# EasyEDA Pro project Arduino UNO DIY.eprj, board Arduino_Uno_Kit_ASCII
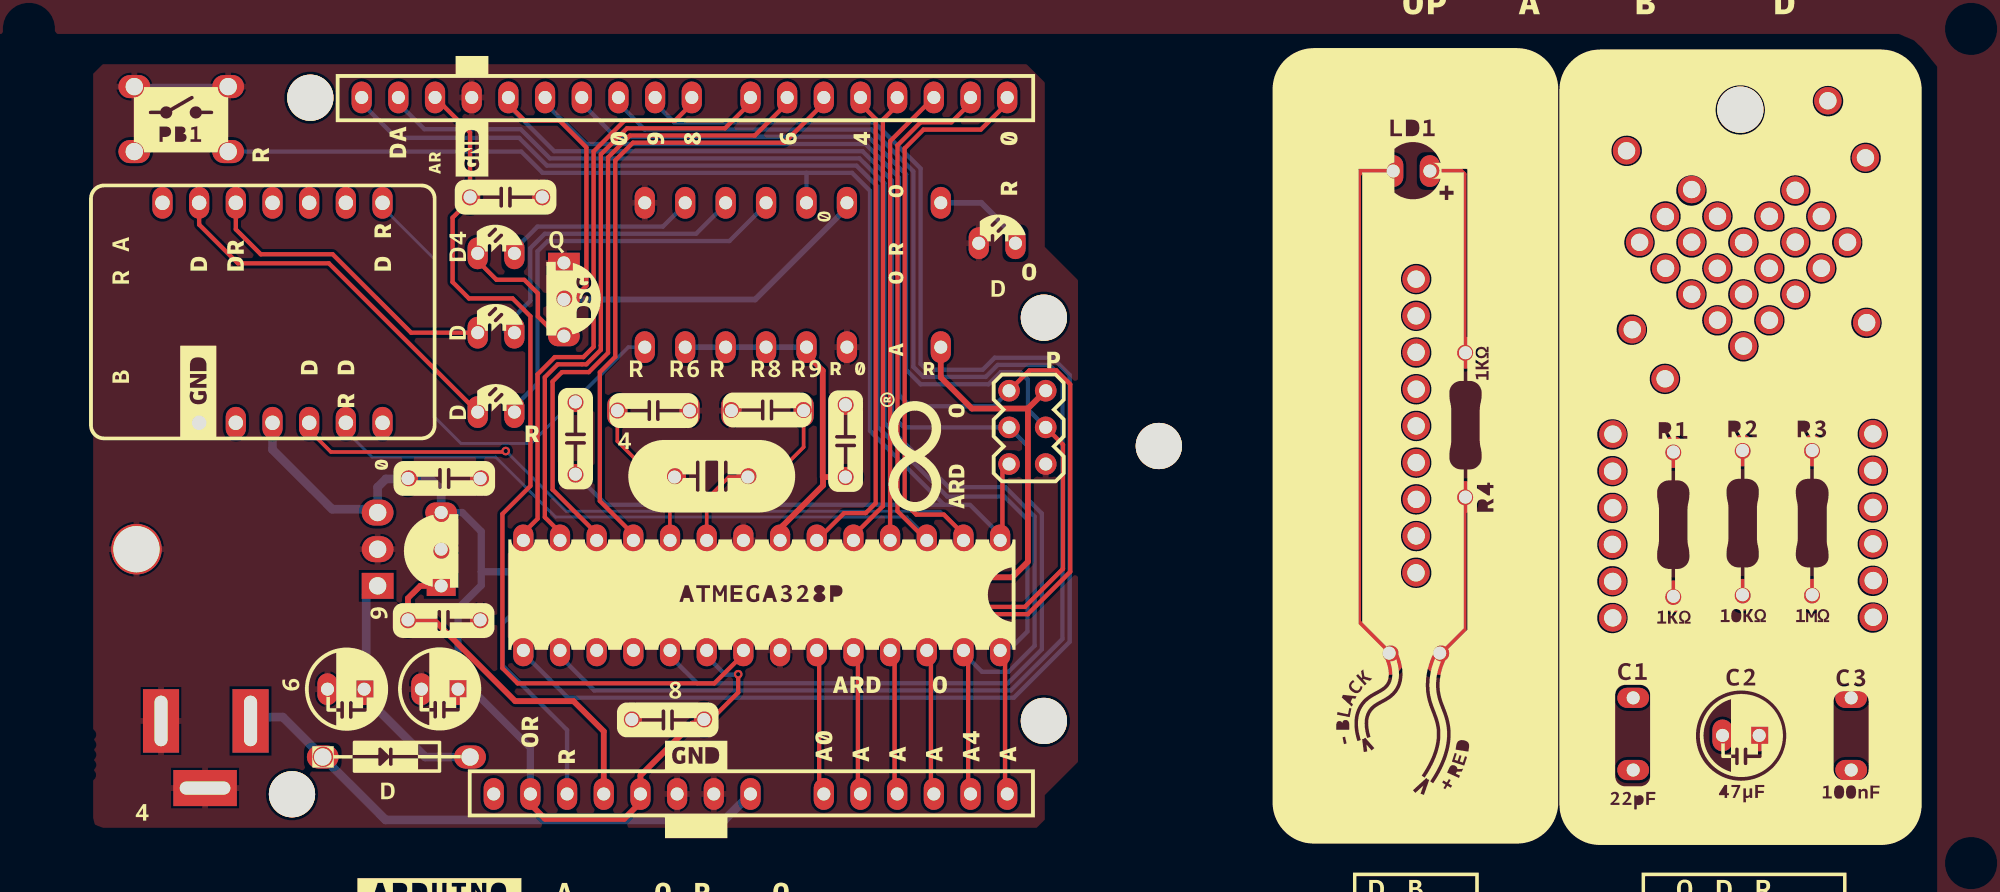
[diagram p6: board, top side]
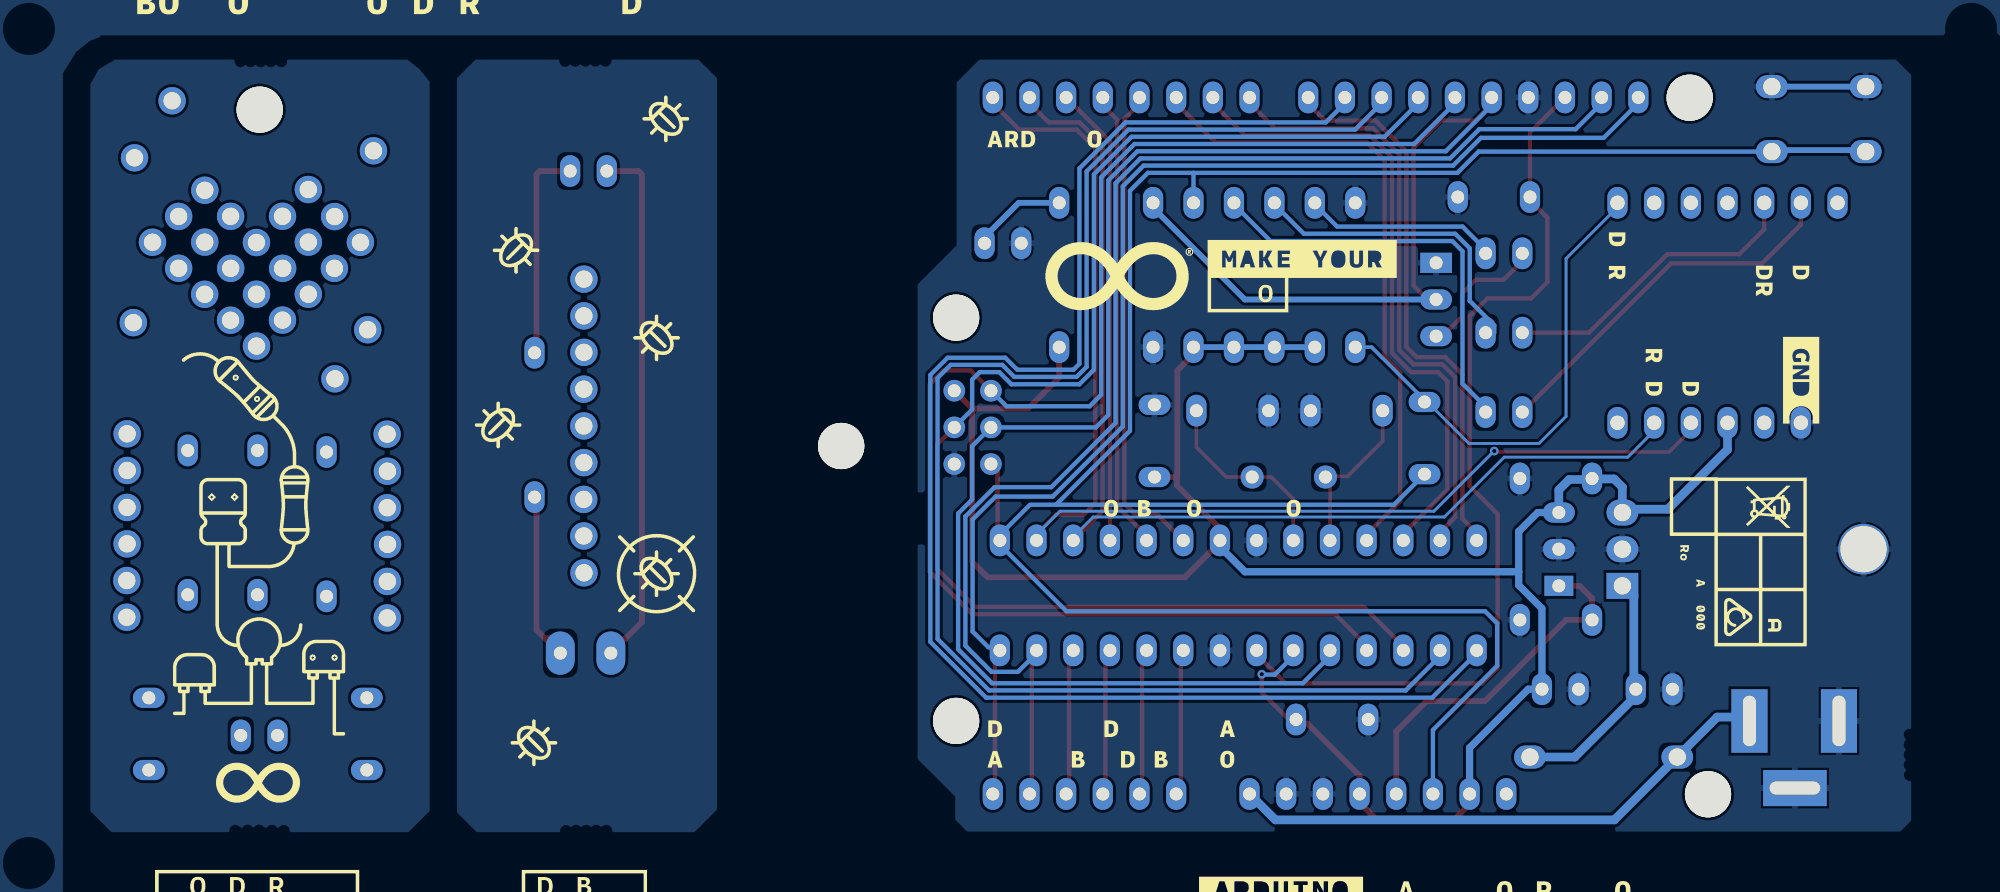
[diagram p7: board, bottom side, seen from below]

No outline. copper layers: Top Layer, Bottom Layer. Coordinates in mm from the lowest, leftmost part position.
Stack: Top Layer 0.018mm / Dielectric2 1.564mm FR-4 er 4.8 / Bottom Layer 0.018mm

## Design rules (mm)
net U1: Aruino_Uno_Kit
net PB1: Aruino_Uno_Kit
net D1: Aruino_Uno_Kit
net Q1: Aruino_Uno_Kit
net U2: Aruino_Uno_Kit
net Y1: Aruino_Uno_Kit
net U3: Aruino_Uno_Kit
net R24: Aruino_Uno_Kit
net J5: Aruino_Uno_Kit
net R1: Aruino_Uno_Kit
net R7: Aruino_Uno_Kit
net R8: Aruino_Uno_Kit
net R2: Aruino_Uno_Kit
net J2: Aruino_Uno_Kit
net J6: Aruino_Uno_Kit
net R3: Aruino_Uno_Kit
net R4: Aruino_Uno_Kit
net R5: Aruino_Uno_Kit
net R9: Aruino_Uno_Kit
net R11: Aruino_Uno_Kit
net R10: Aruino_Uno_Kit
net R6: Aruino_Uno_Kit
net C5: Aruino_Uno_Kit
net C3: Aruino_Uno_Kit
net C4: Aruino_Uno_Kit
net LD3: Aruino_Uno_Kit
net LD1: Aruino_Uno_Kit
net LD2: Aruino_Uno_Kit
net LD4: Aruino_Uno_Kit
net LD5: Aruino_Uno_Kit
net J7: Aruino_Uno_Kit
net C1: Aruino_Uno_Kit
net J3: Aruino_Uno_Kit
net C2: Aruino_Uno_Kit
net J1: Aruino_Uno_Kit
net J4: Aruino_Uno_Kit
net C7: Aruino_Uno_Kit
net C8: Aruino_Uno_Kit
net C6: Aruino_Uno_Kit
net C9: Aruino_Uno_Kit
net C10: Aruino_Uno_Kit
net C11: Aruino_Uno_Kit
net C13: Aruino_Uno_Kit
net C12: Aruino_Uno_Kit
spacing BoardOutlineClearance: track to track 0.2, other pairs 0.127 to 0.3
spacing Silks: track to track 0.2, other pairs 0.127 to 0.3
spacing Generic clearance 0.127mm: track to track 0.2, other pairs 0.127 to 0.3
spacing COPPER_0.3mm: track to track 0.2, other pairs 0.127 to 0.3
spacing safeClearance (default): track to track 0.2, other pairs 0.127 to 0.3
track width StandardTraces (default): min 0.127, default 0.4, max 5
differential pair USB (default): width min 0.15, default 0.2, max 0.21; gap min 0.15, default 0.15
via StandardVias (default): diameter min 0.6, default 0.6, max 0.6; hole min 0.3, default 0.3, max 0.3

## Placement (name value [footprint] x y rotation side)
C1  -  [TS170R1H220JSANB0R]  111.1 8.95 90 top
C2  -  [EKF476M1EE05TU]  118.56 8.85 0 top
C3  -  [B32529C0104J289]  126.2 8.95 90 top
C4  -  [TS170R1H220JSANB0R]  43.25 31.35 0 top
C5  -  [TS170R1H220JSANB0R]  51.15 31.35 180 top
C6  -  [EKF476M1EE05TU]  21.95 12.05 0 top
C7  -  [EKF476M1EE05TU]  28.45 12.05 0 top
C8  -  [B32529C0104J289]  44.25 9.95 180 top
C9  -  [B32529C0104J289]  28.75 16.85 0 top
C10  -  [B32529C0104J289]  28.75 26.65 0 top
C11  -  [B32529C0104J289]  33.05 46.15 0 top
C12  -  [B32529C0104J289]  37.85 29.45 90 top
C13  -  [B32529C0104J289]  56.55 29.25 90 top
D1  1N4007G-T  [1N4007G-T-Footprint-1]  25.35 7.35 0 top
J1  20TW-995  [1X14-CUSTOM]  49.97 4.79 0 top
J2  20TW-994  [1X18-CUSTOM]  49.97 53.05 180 top
J3  PH2-06-UA  [2X03]  69.15 30.19 90 top
J4  19TW-746  [POWERSUPPLY_DC-21MM]  9.15 9.85 0 top
J5  -  [USB-C Serial-Footprint (16U2)]  16.17 38.13 270 top
J6  -  [MK125002GO]  95.95 14.55 180 top
J7  ICS-328-T  [ICS-328-T-Footprint-1]  50.65 18.45 180 top
LD1  L-7104YD  [L314YD-Footprint-1]  95.75 47.95 180 top
LD2  L-7104YD  [L314YD-Footprint-1]  32.35 31.25 180 top
LD3  L-7104YD  [L314YD-Footprint-1]  32.35 36.75 180 top
LD4  L-7104YD  [L314YD-Footprint-1]  32.35 42.25 180 top
LD5  L-7104GD  [L314YD-Footprint-1]  67.05 42.95 180 top
NOREF  -  [Pad_ie141]  118.52 52.2 0 top
NOREF#2  -  [Pad_ie91]  115.15 39.42 90 top
NOREF#3  -  [Pad_ie90]  113.34 41.21 90 top
NOREF#4  -  [Pad_ie110]  72.73 22.48 90 top
NOREF#5  -  [Pad_ie103]  4.26 7.5 270 top
NOREF#6  -  [Pad_ie96]  115.15 43.02 90 top
NOREF#7  -  [Pad_ie109]  72.72 23.18 90 top
NOREF#8  -  [Pad_ie118]  95.91 2.25 0 top
NOREF#9  -  [Pad_ie137]  122.32 46.62 90 top
NOREF#10  -  [Pad_ie82]  96.07 22.67 90 top
NOREF#11  -  [Pad_ie78]  109.66 22.08 90 top
NOREF#12  -  [Pad_ie62]  96.06 20.12 90 top
NOREF#13  -  [Pad_ie128]  94.57 55.58 0 top
NOREF#14  -  [Pad_ie121]  97.31 2.24 0 top
NOREF#15  -  [Pad_ie93]  120.53 41.21 90 top
NOREF#16  -  [Pad_ie72]  127.7 24.64 90 top
NOREF#17  -  [Pad_ie79]  109.68 24.62 90 top
NOREF#18  -  [Pad_ie70]  127.72 17.03 90 top
NOREF#19  -  [Pad_ie94]  122.33 39.41 90 top
NOREF#20  -  [Pad_ie148]  18.22 4.77 0 top
NOREF#21  -  [Pad_ie146]  70.29 9.85 0 top
NOREF#22  -  [Pad_ie142]  95.27 55.59 0 top
NOREF#23  -  [Pad_ie116]  120.21 2.25 0 top
NOREF#24  -  [Pad_ie105]  4.26 8.9 270 top
NOREF#25  -  [Pad_ie61]  118.74 39.42 90 top
NOREF#26  -  [Pad_ie73]  127.7 22.12 90 top
NOREF#27  -  [Pad_ie135]  115.15 46.67 90 top
NOREF#28  -  [Pad_ie139]  124.13 44.81 90 top
NOREF#29  -  [Pad_ie122]  119.15 55.55 180 top
NOREF#30  -  [Pad_ie145]  70.29 37.79 0 top
NOREF#31  -  [Pad_ie133]  116.94 44.82 90 top
NOREF#32  -  [Pad_ie119]  95.21 2.25 0 top
NOREF#33  -  [Pad_ie89]  96.07 35.39 90 top
NOREF#34  -  [Pad_ie71]  127.72 19.58 90 top
NOREF#35  -  [Pad_ie124]  117.75 55.55 0 top
NOREF#36  -  [Pad_ie115]  116.85 2.25 0 top
NOREF#37  -  [Pad_ie117]  96.61 2.25 180 top
NOREF#38  -  [Pad_ie99]  0 0 90 top
NOREF#39  -  [Pad_ie126]  119.85 55.55 0 top
NOREF#40  -  [Pad_ie80]  109.68 19.52 90 top
NOREF#41  -  [Pad_ie76]  109.69 29.72 90 top
NOREF#42  -  [Pad_ie66]  116.94 37.62 90 top
NOREF#43  -  [Pad_ie131]  122.32 43.03 90 top
NOREF#44  -  [Pad_ie107]  72.73 24.58 270 top
NOREF#45  -  [Pad_ie125]  117.03 55.55 0 top
NOREF#46  -  [Pad_ie98]  134.5 57.8 270 top
NOREF#47  -  [Pad_ie74]  127.69 27.2 90 top
NOREF#48  -  [Pad_ie144]  96.67 55.58 180 top
NOREF#49  -  [Pad_ie97]  78.25 28.9 0 top
NOREF#50  -  [Pad_ie140]  125.94 43.02 90 top
NOREF#51  -  [Pad_ie123]  118.45 55.55 0 top
NOREF#52  -  [Pad_ie85]  96.07 27.75 90 top
NOREF#53  -  [Pad_ie147]  19.49 53.03 0 top
NOREF#54  -  [Pad_ie65]  118.74 35.82 90 top
NOREF#55  -  [Pad_ie134]  111.54 43.01 90 top
NOREF#56  -  [Pad_ie102]  4.26 6.8 90 top
NOREF#57  -  [Pad_ie64]  113.31 33.56 90 top
NOREF#58  -  [Pad_ie129]  127.19 48.87 90 top
NOREF#59  -  [Pad_ie138]  120.53 44.81 90 top
NOREF#60  -  [Pad_ie87]  96.06 37.92 90 top
NOREF#61  -  [Pad_ie81]  109.68 16.99 90 top
NOREF#62  -  [Pad_ie112]  119.35 2.26 180 top
NOREF#63  -  [Pad_ie69]  111.04 36.96 90 top
NOREF#64  -  [Pad_ie136]  113.33 44.8 90 top
NOREF#65  -  [Pad_ie143]  95.97 55.58 0 top
NOREF#66  -  [Pad_ie75]  127.7 29.74 90 top
NOREF#67  -  [Pad_ie77]  109.67 27.15 90 top
NOREF#68  -  [Pad_ie108]  72.73 23.88 90 top
NOREF#69  -  [Pad_ie63]  110.64 49.35 90 top
NOREF#70  -  [Pad_ie127]  97.37 55.57 0 top
NOREF#71  -  [Pad_ie111]  72.74 25.28 90 top
NOREF#72  -  [Pad_ie84]  96.07 30.29 90 top
NOREF#73  -  [Pad_ie106]  4.25 6.1 270 top
NOREF#74  -  [Pad_ie132]  124.58 52.82 90 top
NOREF#75  -  [Pad_ie83]  96.08 25.2 90 top
NOREF#76  -  [Pad_ie86]  96.07 32.84 90 top
NOREF#77  -  [Pad_ie92]  116.93 41.21 90 top
NOREF#78  -  [Pad_ie114]  117.67 2.25 0 top
NOREF#79  -  [Pad_ie120]  94.51 2.25 0 top
NOREF#80  -  [Pad_ie113]  118.55 2.26 0 top
NOREF#81  -  [Pad_ie95]  118.74 43 90 top
NOREF#82  -  [Pad_ie130]  124.13 41.21 90 top
NOREF#83  -  [Pad_ie104]  4.27 8.2 270 top
NOREF#84  -  [Pad_ie100]  134.5 0 270 top
NOREF#85  -  [Pad_ie67]  127.27 37.45 90 top
NOREF#86  -  [Pad_ie68]  120.54 37.61 90 top
NOREF#87  -  [Pad_ie101]  0 57.8 270 top
NOREF#88  -  [Pad_ie88]  96.06 40.46 90 top
PB1  TS21043-160B-5227260  [SW6X6]  10.55 51.55 0 top
Q1  2N7000BU  [SOT23]  37.05 39.05 270 top
R1  2-1623930-9  [A5215]  113.89 23.48 270 top
R2  0-1623930-3  [A5213]  118.67 23.59 90 top
R3  3-1623930-5  [A5217]  123.5 23.59 270 top
R4  2-1623930-9  [A5215]  99.49 30.36 90 top
R5  2-1623930-9  [A5215]  42.65 40.75 90 top
R6  2-1623930-9  [A5215]  45.45 40.75 90 top
R7  2-1623930-9  [A5215]  48.25 40.75 90 top
R8  2-1623930-9  [A5215]  51.05 40.75 90 top
R9  0-1623930-3  [A5213]  53.85 40.75 270 top
R10  3-1623930-5  [A5217]  56.65 40.75 270 top
R11  2-1623930-9  [A5215]  63.15 40.75 90 top
U1  ATMEGA328P-PU  [DIL28-3]  50.75 18.55 180 top
U2  LE33CZ  [LE33CZ-TR/AP]  28.55 21.75 90 top
U3  L7805ABP  [TO220]  24.15 21.75 90 top
Y1  ECS-160-20-4X-DU  [ECS-160-20-4X-DU-Footprint-1]  47.25 26.75 180 top

## Footprints (pads in the part's own frame, mm; a bottom-side part is the same pattern mirrored in y, then rotated)
1N4007G-T-Footprint-1
  rrect 2.2x1.6 hole 1.2: 1(-5,0)
  oval 2.2x1.6 hole 1.2: 2(5.2,0)
1X14-CUSTOM
  oval 1.4x2.2 hole 0.9: 1(-17.78,0) 2(-15.24,0) 3(-12.7,0) 4(-10.16,0) 5(-7.62,0) 6(-5.08,0) 7(-2.54,0) 8(0,0) 9(5.08,0) 10(7.62,0) 11(10.16,0) 12(12.7,0) 13(15.24,0) 14(17.78,0)
1X18-CUSTOM
  oval 1.4x2.2 hole 0.9: 1(-17.78,0) 2(-15.24,0) 3(-12.7,0) 4(-10.16,0) 5(-7.62,0) 6(-5.08,0) 7(-2.54,0) 8(0,0) 9(4.064,0) 10(6.604,0) 11(9.144,0) 12(11.684,0) 13(14.224,0) 14(16.764,0) 15(19.304,0) 16(21.844,0) 17(24.384,0) 18(26.924,0)
2X03
  rrect 1.5x1.5 hole 0.9: 1(2.54,1.27) 2(2.54,-1.27) 3(0,1.27) 4(0,-1.27) 5(-2.54,1.27) 6(-2.54,-1.27)
A5213
  oval 2.2x1.4 hole 0.9: 1(-5,0) 2(5,0)
A5215
  oval 2.2x1.4 hole 0.9: 1(-5,0) 2(5,0)
A5217
  oval 2.2x1.4 hole 0.9: 1(-5,0) 2(5,0)
B32529C0104J289
  oval 1.4x2.2 hole 0.9: 1(-2.5,0) 2(2.5,0)
DIL28-3
  oval 1.4x2.2 hole 0.9: 1(-16.51,-3.81) 2(-13.97,-3.81) 3(-11.43,-3.81) 4(-8.89,-3.81) 5(-6.35,-3.81) 6(-3.81,-3.81) 7(-1.27,-3.81) 8(1.27,-3.81) 9(3.81,-3.81) 10(6.35,-3.81) 11(8.89,-3.81) 12(11.43,-3.81) 13(13.97,-3.81) 14(16.51,-3.81) 15(16.51,3.81) 16(13.97,3.81) 17(11.43,3.81) 18(8.89,3.81) 19(6.35,3.81) 20(3.81,3.81) 21(1.27,3.81) 22(-1.27,3.81) 23(-3.81,3.81) 24(-6.35,3.81) 25(-8.89,3.81) 26(-11.43,3.81) 27(-13.97,3.81) 28(-16.51,3.81)
ECS-160-20-4X-DU-Footprint-1
  rrect 1.6x1.6 hole 0.9: 1(-2.54,0) 2(2.54,0)
EKF476M1EE05TU
  oval 1.4x2.2 hole 0.9: 1(-1.27,0)
  rrect 1.4x2.2 hole 0.9: 2(1.27,0)
L314YD-Footprint-1
  rrect 1.4x2.2 hole 0.9: A(-1.27,0)
  oval 1.4x2.2 hole 0.9: C(1.27,0)
LE33CZ-TR/AP
  rect 1.4x2 hole 0.9: 1(-2.54,0)
  oval 1.4x2.2 hole 0.9: 2(0,0) 3(2.54,0)
MK125002GO
  rrect 2x3 hole 0.9: 1(-1.75,0)
  oval 2x3 hole 0.9: 2(1.75,0)
Pad_ie61
  round 1.9 hole 1.2: 0(0,0)
Pad_ie62
  round 1.9 hole 1.2: 0(0,0)
Pad_ie63
  round 1.9 hole 1.2: 0(0,0)
Pad_ie64
  round 1.9 hole 1.2: 0(0,0)
Pad_ie65
  round 1.9 hole 1.2: 0(0,0)
Pad_ie66
  round 1.9 hole 1.2: 0(0,0)
Pad_ie67
  round 1.9 hole 1.2: 0(0,0)
Pad_ie68
  round 1.9 hole 1.2: 0(0,0)
Pad_ie69
  round 1.9 hole 1.2: 0(0,0)
Pad_ie70
  round 1.9 hole 1.2: 0(0,0)
Pad_ie71
  round 1.9 hole 1.2: 0(0,0)
Pad_ie72
  round 1.9 hole 1.2: 0(0,0)
Pad_ie73
  round 1.9 hole 1.2: 0(0,0)
Pad_ie74
  round 1.9 hole 1.2: 0(0,0)
Pad_ie75
  round 1.9 hole 1.2: 0(0,0)
Pad_ie76
  round 1.9 hole 1.2: 0(0,0)
Pad_ie77
  round 1.9 hole 1.2: 0(0,0)
Pad_ie78
  round 1.9 hole 1.2: 0(0,0)
Pad_ie79
  round 1.9 hole 1.2: 0(0,0)
Pad_ie80
  round 1.9 hole 1.2: 0(0,0)
Pad_ie81
  round 1.9 hole 1.2: 0(0,0)
Pad_ie82
  round 1.9 hole 1.2: 0(0,0)
Pad_ie83
  round 1.9 hole 1.2: 0(0,0)
Pad_ie84
  round 1.9 hole 1.2: 0(0,0)
Pad_ie85
  round 1.9 hole 1.2: 0(0,0)
Pad_ie86
  round 1.9 hole 1.2: 0(0,0)
Pad_ie87
  round 1.9 hole 1.2: 0(0,0)
Pad_ie88
  round 1.9 hole 1.2: 0(0,0)
Pad_ie89
  round 1.9 hole 1.2: 0(0,0)
Pad_ie90
  round 1.9 hole 1.2: 0(0,0)
Pad_ie91
  round 1.9 hole 1.2: 0(0,0)
Pad_ie92
  round 1.9 hole 1.2: 0(0,0)
Pad_ie93
  round 1.9 hole 1.2: 0(0,0)
Pad_ie94
  round 1.9 hole 1.2: 0(0,0)
Pad_ie95
  round 1.9 hole 1.2: 0(0,0)
Pad_ie96
  round 1.9 hole 1.2: 0(0,0)
Pad_ie97
  round 3.2 hole 3.2: (0,0)
Pad_ie98
  round 0.003 hole 3.2: 22(0,0)
Pad_ie99
  round 0.003 hole 3.2: 22(0,0)
Pad_ie100
  round 0.003 hole 3.2: 22(0,0)
Pad_ie101
  round 0.003 hole 3.2: 22(0,0)
Pad_ie102
  round 0.003 hole 0.4: MOUSEBITES(0,0)
Pad_ie103
  round 0.003 hole 0.4: MOUSEBITES(0,0)
Pad_ie104
  round 0.003 hole 0.4: MOUSEBITES(0,0)
Pad_ie105
  round 0.003 hole 0.4: MOUSEBITES(0,0)
Pad_ie106
  round 0.003 hole 0.4: MOUSEBITES(0,0)
Pad_ie107
  round 0.003 hole 0.4: MOUSEBITES(0,0)
Pad_ie108
  round 0.003 hole 0.4: MOUSEBITES(0,0)
Pad_ie109
  round 0.003 hole 0.4: MOUSEBITES(0,0)
Pad_ie110
  round 0.003 hole 0.4: MOUSEBITES(0,0)
Pad_ie111
  round 0.003 hole 0.4: MOUSEBITES(0,0)
Pad_ie112
  round 0.003 hole 0.4: MOUSEBITES(0,0)
Pad_ie113
  round 0.003 hole 0.4: MOUSEBITES(0,0)
Pad_ie114
  round 0.003 hole 0.4: MOUSEBITES(0,0)
Pad_ie115
  round 0.003 hole 0.4: MOUSEBITES(0,0)
Pad_ie116
  round 0.003 hole 0.4: MOUSEBITES(0,0)
Pad_ie117
  round 0.003 hole 0.4: MOUSEBITES(0,0)
Pad_ie118
  round 0.003 hole 0.4: MOUSEBITES(0,0)
Pad_ie119
  round 0.003 hole 0.4: MOUSEBITES(0,0)
Pad_ie120
  round 0.003 hole 0.4: MOUSEBITES(0,0)
Pad_ie121
  round 0.003 hole 0.4: MOUSEBITES(0,0)
Pad_ie122
  round 0.003 hole 0.4: MOUSEBITES(0,0)
Pad_ie123
  round 0.003 hole 0.4: MOUSEBITES(0,0)
Pad_ie124
  round 0.003 hole 0.4: MOUSEBITES(0,0)
Pad_ie125
  round 0.003 hole 0.4: MOUSEBITES(0,0)
Pad_ie126
  round 0.003 hole 0.4: MOUSEBITES(0,0)
Pad_ie127
  round 0.003 hole 0.4: MOUSEBITES(0,0)
Pad_ie128
  round 0.003 hole 0.4: MOUSEBITES(0,0)
Pad_ie129
  round 1.9 hole 1.2: 0(0,0)
Pad_ie130
  round 1.9 hole 1.2: 0(0,0)
Pad_ie131
  round 1.9 hole 1.2: 0(0,0)
Pad_ie132
  round 1.9 hole 1.2: 0(0,0)
Pad_ie133
  round 1.9 hole 1.2: 0(0,0)
Pad_ie134
  round 1.9 hole 1.2: 0(0,0)
Pad_ie135
  round 1.9 hole 1.2: 0(0,0)
Pad_ie136
  round 1.9 hole 1.2: 0(0,0)
Pad_ie137
  round 1.9 hole 1.2: 0(0,0)
Pad_ie138
  round 1.9 hole 1.2: 0(0,0)
Pad_ie139
  round 1.9 hole 1.2: 0(0,0)
Pad_ie140
  round 1.9 hole 1.2: 0(0,0)
Pad_ie141
  round 3.2 hole 3.2: (0,0)
Pad_ie142
  round 0.003 hole 0.4: MOUSEBITES(0,0)
Pad_ie143
  round 0.003 hole 0.4: MOUSEBITES(0,0)
Pad_ie144
  round 0.003 hole 0.4: MOUSEBITES(0,0)
Pad_ie145
  round 3.2 hole 3.2: (0,0)
Pad_ie146
  round 3.2 hole 3.2: (0,0)
Pad_ie147
  round 3.2 hole 3.2: (0,0)
Pad_ie148
  round 3.2 hole 3.2: (0,0)
POWERSUPPLY_DC-21MM
  rect 2.5x4.4 hole 0.9x3.5: 1(6.2,0) 3(0,0)
  rect 4.4x2.5 hole 3.5x0.9: 2(3.05,-4.65)
SOT23
  rect 1.4x2.2 hole 0.9: 1(-2.54,0)
  oval 1.4x2.2 hole 0.9: 2(0,0) 3(2.54,0)
SW6X6
  oval 2.2x1.6 hole 1.2: 1(-3.25,2.25) 2(3.25,2.25) 3(-3.25,-2.25) 4(3.25,-2.25)
TO220
  rect 1.8x2.2 hole 1.2: 1(-2.54,0)
  oval 1.8x2.2 hole 1.2: 2(0,0) 3(2.54,0)
  round 3.5 hole 3.2: 4(0,16.7)
TS170R1H220JSANB0R
  oval 1.4x2.2 hole 0.9: 1(-2.5,0) 2(2.5,0)
USB-C Serial-Footprint (16U2)
  oval 2.2x1.4 hole 1: 1(-7.62,-6.92) 2(-7.62,-4.38) 3(-7.62,-1.84) 4(-7.62,0.7) 5(-7.62,3.24) 6(-7.62,5.78) 7(-7.62,8.32) 8(7.62,8.32) 9(7.62,5.78) 10(7.62,3.24) 11(7.62,0.7) 12(7.62,-1.84) 13(7.62,-4.38)

## Nets
+3V3: C9.1 J1.4 U2.1
+5V: C7.2 C8.1 C10.1 C13.1 J1.2 J1.5 J3.2 J5.11 R6.1 R7.1 R8.1 R9.2 R11.1 U1.7 U1.20 U2.3 U3.3
GND: C4.2 C5.2 C6.1 C7.1 C8.2 C9.2 C10.2 C11.2 C13.2 J1.6 J1.7 J2.15 J3.6 J4.2 J4.3 J5.13 LD5.C PB1.1 PB1.2 Q1.1 R5.2 R10.2 U1.8 U1.22 U2.2 U3.2 U3.4
VIN: D1.1 J1.8 J4.1
AD0: J1.9 U1.23
AD1: J1.10 U1.24
AD2: J1.11 U1.25
AD3: J1.12 U1.26
AD4/SDA: J1.13 J2.17 U1.27
AD5/SCL: J1.14 J2.18 U1.28
AREF: C11.1 J2.16 U1.21
DTR: C12.2 J5.7 R5.1
IO0: J2.1 J5.10 U1.2
IO1: J2.2 J5.9 U1.3
IO2: J2.3 U1.4
IO3: J2.4 U1.5
IO4: J2.5 U1.6
IO5: J2.6 U1.11
IO6: J2.7 U1.12
IO7: J2.8 U1.13
IO8: J2.9 U1.14
IO9: J2.10 U1.15
MISO: J2.13 J3.1 U1.18
MOSI: J2.12 J3.4 U1.17
NETC4_1: C4.1 U1.10 Y1.2
NETC5_1: C5.1 U1.9 Y1.1
NETC6_2: C6.2 D1.2 U3.1
NETJ5_2: J5.2 LD2.C
NETJ5_3: J5.3 LD3.C
NETJ6_1: J6.1 R4.1
NETJ6_2: J6.2 LD1.C
NETLD1_A: LD1.A R4.2
NETLD2_A: LD2.A R8.2
NETLD3_A: LD3.A R7.2
NETLD4_A: LD4.A R6.2
NETLD4_C: LD4.C Q1.3
NETLD5_A: LD5.A R11.2
RESET: C12.1 J1.3 J3.5 PB1.3 PB1.4 R9.1 U1.1
SCK: J2.14 J3.3 Q1.2 R10.1 U1.19
SS: J2.11 U1.16

Pads without a net: C1 1 2; C2 1 2; C3 1 2; J1 1; J5 1 4 5 6 8 12; NOREF#2 0; NOREF#3 0; NOREF#4 MOUSEBITES; NOREF#5 MOUSEBITES; NOREF#6 0; NOREF#7 MOUSEBITES; NOREF#8 MOUSEBITES; NOREF#9 0; NOREF#10 0; NOREF#11 0; NOREF#12 0; NOREF#13 MOUSEBITES; NOREF#14 MOUSEBITES; NOREF#15 0; NOREF#16 0; NOREF#17 0; NOREF#18 0; NOREF#19 0; NOREF#22 MOUSEBITES; NOREF#23 MOUSEBITES; NOREF#24 MOUSEBITES; NOREF#25 0; NOREF#26 0; NOREF#27 0; NOREF#28 0; NOREF#29 MOUSEBITES; NOREF#31 0; NOREF#32 MOUSEBITES; NOREF#33 0; NOREF#34 0; NOREF#35 MOUSEBITES; NOREF#36 MOUSEBITES; NOREF#37 MOUSEBITES; NOREF#38 22; NOREF#39 MOUSEBITES; NOREF#40 0; NOREF#41 0; NOREF#42 0; NOREF#43 0; NOREF#44 MOUSEBITES; NOREF#45 MOUSEBITES; NOREF#46 22; NOREF#47 0; NOREF#48 MOUSEBITES; NOREF#50 0; NOREF#51 MOUSEBITES; NOREF#52 0; NOREF#54 0; NOREF#55 0; NOREF#56 MOUSEBITES; NOREF#57 0; NOREF#58 0; NOREF#59 0; NOREF#60 0; NOREF#61 0; NOREF#62 MOUSEBITES; NOREF#63 0; NOREF#64 0; NOREF#65 MOUSEBITES; NOREF#66 0; NOREF#67 0; NOREF#68 MOUSEBITES; NOREF#69 0; NOREF#70 MOUSEBITES; NOREF#71 MOUSEBITES; NOREF#72 0; NOREF#73 MOUSEBITES; NOREF#74 0; NOREF#75 0; NOREF#76 0; NOREF#77 0; NOREF#78 MOUSEBITES; NOREF#79 MOUSEBITES; NOREF#80 MOUSEBITES; NOREF#81 0; NOREF#82 0; NOREF#83 MOUSEBITES; NOREF#84 22; NOREF#85 0; NOREF#86 0; NOREF#87 22; NOREF#88 0; R1 1 2; R2 1 2; R3 1 2

## Via types
v1: diameter 0.6, hole 0.3, Top Layer to Bottom Layer, 2 vias

## Routing (per net, layer and track width the routed paths; a pad name or vN(x,y) marks a point on that pad's centre or on a via; arc(x,y) is an arc through that point)
+3V3: length 25
  Top Layer w0.4: 26.75,16.85 28.05,16.85 33.68,11.22 37.72,11.22 39.81,9.13 J1.4 ; C9.1 26.25,18.35 27.11,19.21 28.75,19.21
+5V: length 156.1
  Top Layer w0.3: v1(49.12,13.09) 49.12,11.82 47.25,9.95 C8.1
  Top Layer w0.4: 69.18,31.5 J3.2 ; 69.18,31.5 69.18,20.88 68.1,19.8 54.45,19.8 52.02,22.23 52.21,22.42 52.21,23.38 54.99,26.16 54.99,26.75 ; 69.18,31.5 65.3,31.5 63.15,33.65 R11.1 ; 54.99,26.75 54.98,26.75 54.98,34.12 53.85,35.25 R9.2 ; 54.99,26.75 C13.1 ; J1.2 34.73,4.09 35.75,3.07 41.22,3.07 42.35,4.2 J1.5 42.35,6.07 45.95,9.67 46.47,9.67 C8.1
  Bottom Layer w0.3: U1.20 46.94,14.34 48.22,13.06 49.09,13.06 v1(49.12,13.09)
  Bottom Layer w0.4: 45.15,35.75 47.95,35.75 ; 47.95,35.75 R7.1 R8.1 53.55,35.75
  Bottom Layer w0.5: U2.3 30.01,24.29 31.33,22.97 31.33,20.19 ; 31.33,20.19 50.29,20.19 52.02,21.92 U1.7 52.02,22.82 ; 31.33,20.19 31.33,19.25 29.72,17.64 C7.2 ; J1.2 34.73,7.99 30.67,12.05 30.05,12.05
  Bottom Layer w0.6: 26.28,26.62 24.72,26.62 24.15,26.05 U3.3 23.92,24.52 21,24.52 16.87,28.65 J5.11 ; U2.3 28.55,25.86 27.83,26.58 26.32,26.58 C10.1 26.25,26.47
GND: length 5.9
  Bottom Layer w0.4: PB1.1 13.25,53.8
VIN: length 38.5
  Bottom Layer w0.6: J1.8 48.18,3 24.7,3 20.35,7.35 ; 15.12,10.12 17.58,10.12 20.33,7.37
AD0: length 10.2
  Top Layer w0.3: U1.23 54.73,14.57 54.73,5.81 55.05,5.49 J1.9
AD1: length 10.2
  Top Layer w0.3: U1.24 57.1,14.15 57.41,13.84 57.41,4.97 J1.10
AD2: length 10.2
  Top Layer w0.3: J1.11 59.95,4.97 59.95,13.84 59.64,14.15 U1.25
AD3: length 10.2
  Top Layer w0.3: U1.26 62.18,14.15 62.47,13.86 62.47,4.99 J1.12
AD4/SDA: length 91.6
  Top Layer w0.3: U1.27 64.72,14.15 65.05,13.82 65.05,4.95 J1.13
  Bottom Layer w0.3: 64.52,14.74 66.01,13.25 67.84,13.25 69.65,15.07 69.65,24.01 67.61,26.05 63.7,26.05 59.25,30.5 59.25,47.1 57.52,48.82 36.08,48.82 34.06,50.85 27.39,50.85 25.59,52.65 J2.17
AD5/SCL: length 88.5
  Top Layer w0.3: J1.14 67.6,4.94 67.6,13.81 67.26,14.15 U1.28
  Bottom Layer w0.3: U1.28 67.48,14.96 68.06,14.96 69.15,16.05 69.15,23.81 67.56,25.4 63.6,25.4 58.75,30.25 58.75,46.89 57.31,48.32 35.88,48.32 33.95,50.25 25.45,50.25 23.05,52.65 J2.18
AREF: length 64.1
  Top Layer w0.3: J2.16 28.13,52.95 28.63,52.44 28.74,52.44 30.55,50.63 30.55,45.93 29.34,44.72 29.34,40.26 30.47,39.12 33.49,39.12 34.73,37.89 34.73,26.13 32.79,24.19 32.79,13.51 33.85,12.45 47.47,12.45 49.48,14.46 U1.21
DTR: length 34.4
  Bottom Layer w0.2: 24.92,45.01 28.05,41.88 28.05,30.95 29.92,29.08 34.78,29.08 37.65,31.95
  Bottom Layer w0.25: 38.47,32.48 37.94,31.95 C12.2 ; C12.2 37.85,32.09 41.51,35.75 R5.1 ; C12.2 37.65,31.95
IO0: length 88
  Top Layer w0.25: J5.10 19.41,29.99 20.91,28.49 32.96,28.49 v1(33.02,28.55)
  Top Layer w0.3: J2.1 67.75,52.65 65.92,50.82 61.95,50.82 60.65,49.52 60.65,24.95 61.45,24.15 63.36,24.15 64.72,22.79 U1.2
  Bottom Layer w0.2: 33.03,28.55 37.2,24.38 63.1,24.38 64.72,22.76 U1.2
IO1: length 79
  Top Layer w0.3: U1.3 60.15,24.39 60.15,49.73 61.74,51.32 63.88,51.32 65.21,52.65 J2.2
  Bottom Layer w0.2: J5.9 21.95,29.95 23.78,28.12 32.33,28.12 36.48,23.98 60.8,23.98 62.18,22.6 U1.3
IO2: length 31.9
  Top Layer w0.3: J2.3 59.64,50.02 U1.4
IO3: length 31.9
  Top Layer w0.3: 57.03,22.43 57.03,22.62 59.14,24.73 59.14,51.51 60.13,52.5 J2.4
IO4: length 33.7
  Top Layer w0.3: U1.6 56.45,24.25 57.95,24.25 58.64,24.94 58.64,51.56 57.59,52.61 J2.5
IO5: length 44.2
  Top Layer w0.3: J2.6 55.05,52.65 52.31,49.91 41.83,49.91 40.61,48.69 40.61,35.08 39.54,34.01 39.54,25.09 41.86,22.77 U1.11
IO6: length 44.8
  Top Layer w0.3: J2.7 52.51,52.65 50.28,50.41 41.63,50.41 40.11,48.89 40.11,35.35 38.77,34.02 36.92,34.02 36.27,33.37 36.27,25.88 39.32,22.83 U1.12
IO7: length 42.2
  Top Layer w0.3: U1.13 36.78,22.92 35.73,23.97 35.73,33.66 36.62,34.56 38.61,34.56 39.61,35.56 39.61,49.1 41.42,50.91 48.21,50.91 49.97,52.67 J2.8
IO8: length 38.7
  Top Layer w0.3: J2.9 45.91,52.61 44.75,51.45 41.25,51.45 39.11,49.31 39.11,35.77 38.4,35.06 36.42,35.06 35.23,33.87 35.23,23.86 34.24,22.87 U1.14
IO9: length 105
  Bottom Layer w0.3: 34.04,14.74 37.32,11.46 68.21,11.46 72.08,15.33 72.08,33.82 70.88,35.02 66.88,35.02 66.05,34.19 62.16,34.19 61.75,34.59 61.75,48.13 58.56,51.32 44.69,51.32 43.37,52.65 J2.10
MISO: length 101.4
  Top Layer w0.3: 67.88,32.73 69.28,34.14 71.15,34.14 72.11,33.18 72.11,20.19 69.18,17.25 44.04,17.25 41.86,15.07 U1.18
  Bottom Layer w0.3: J2.13 35.75,52.65 38.57,49.82 57.94,49.82 60.25,47.51 60.25,32.44 61.04,31.65 66.8,31.65 67.88,32.73
MOSI: length 96.8
  Top Layer w0.3: J3.4 71.61,28.99 71.61,20.39 68.97,17.75 42.05,17.75 39.32,15.02 U1.17
  Bottom Layer w0.3: J3.4 69.18,31.43 69.18,33.5 68.65,34.02 67.3,34.02 66.46,33.18 61.75,33.18 60.75,34.18 60.75,47.72 58.14,50.32 40.61,50.32 38.29,52.65 J2.12
NETC4_1: length 11.2
  Top Layer w0.25: 40.75,31.4 40.75,29.23 43.19,26.79 44.06,26.79 44.54,26.31 44.54,26.25 44.39,26.1 44.39,22.37
NETC5_1: length 13.6
  Top Layer w0.25: U1.9 46.94,25.22 48.47,26.75 Y1.1 51.58,26.75 53.65,28.82 C5.1
NETC6_2: length 17.2
  Bottom Layer w0.6: U3.1 23.96,19.21 23.36,18.61 23.36,12.19 C6.2 23.22,11.58 27.45,7.35 D1.2
NETJ5_2: length 26.2
  Top Layer w0.3: J5.2 11.79,44.24 14.47,41.56 20.77,41.56 LD2.C
NETJ5_3: length 21.6
  Top Layer w0.3: J5.3 14.33,43.91 16.06,42.18 21.04,42.18 26.47,36.75 LD3.C
NETJ6_1: length 12.9
  Top Layer w0.4: 97.74,14.55 99.35,16.17 99.35,25.35 ; J6.1 97.7,14.84 98.48,15.62
NETJ6_2: length 36.6
  Top Layer w0.4: J6.2 94.2,14.62 93.29,15.53 93.22,15.53 92.05,16.7 92.05,47.72 92.28,47.95 LD1.C
NETLD1_A: length 14.6
  Top Layer w0.4: 99.35,36.29 99.35,47.72 99.12,47.95 LD1.A ; 99.41,35.3 99.95,34.77
NETLD2_A: length 29
  Bottom Layer w0.3: LD2.A 33.62,31.62 35.22,33.22 35.22,42.39 35.93,43.1 48.52,43.1 50.75,45.34 50.75,45.75
NETLD3_A: length 20.9
  Bottom Layer w0.3: 33.02,36.75 33.02,37.25 34.72,38.96 34.72,42.6 35.72,43.6 46.2,43.6 47.75,45.15 48.05,45.15
NETLD4_A: length 13.4
  Bottom Layer w0.3: 45.15,45.75 45.15,45.35 43.9,44.1 35.22,44.1 33.62,42.5 LD4.A
NETLD4_C: length 9.8
  Top Layer w0.3: 36.36,36.51 36.61,36.51 ; 36.61,36.51 Q1.3 ; 36.61,36.51 35.25,37.87 35.25,39.47 34.31,40.42 32.38,40.42 31.08,41.72 LD4.C
NETLD5_A: length 6.8
  Bottom Layer w0.4: 68.12,42.95 68.12,43.58 65.95,45.75 62.85,45.75
RESET: length 165.9
  Top Layer w0.3: 67.88,27.65 67.42,27.19 67.42,22.52 U1.1
  Bottom Layer w0.25: U1.1 67.26,22.74
  Bottom Layer w0.3: U1.1 67.26,22.06 62.65,17.45 33.66,17.45 32.82,16.61 32.82,13.67 37.27,9.22 J1.3 ; 65.25,24.75 67.26,22.74 ; 53.85,47.82 35.58,47.82 34.1,49.3 PB1.4 ; 53.85,47.82 R9.1 ; 53.85,47.82 57.01,47.82 58.25,46.58 58.25,29.95 63.36,24.84 63.36,24.83 ; 63.36,24.83 65.17,24.83 ; 63.36,24.83 39.97,24.83 C12.1 38.05,26.95 37.25,26.95
  Bottom Layer w0.4: 7.35,49.4 13.1,49.4
SCK: length 139.4
  Top Layer w0.3: J2.14 33.21,52.57 34.32,51.45 36.74,51.45 38.61,49.59 38.61,40 37.65,39.05 36.95,39.05
  Bottom Layer w0.3: J2.14 33.21,52.49 36.38,49.32 57.73,49.32 59.75,47.3 59.75,31.05 60.61,30.19 67.88,30.19 69.18,28.88 69.18,25.19 70.15,24.22 70.15,14.82 67.8,12.46 46.28,12.46 44.2,14.54
  Bottom Layer w0.4: 56.35,45.75 56.35,45.11 50.29,39.05 36.95,39.05
SS: length 103.3
  Bottom Layer w0.3: 36.58,14.54 39.16,11.96 68,11.96 71.58,15.54 71.58,33.61 70.67,34.52 67.09,34.52 66.26,33.69 61.95,33.69 61.25,34.39 61.25,47.92 58.35,50.82 42.65,50.82 40.83,52.65 J2.11

## Copper pours and planes (outline as drawn; the poured copper is in the pictures)
GND on Top Layer: 4.55,54.65 5.15,55.25 69.05,55.25 70.25,54.05 70.25,42.65 72.55,40.35 72.55,7.05 70.25,4.75 70.25,3.05 69.75,2.55 5.14,2.55 4.65,2.74 4.55,3.14
GND on Top Layer: -2.19,61.6 136.35,61.6 136.35,61.5 137.6,60.85 138.3,59.55 138.25,59.5 138.25,-2.33 136.78,-3.8 132.25,-3.8 132.25,55.22 131.18,56.54 130.6,57.08 129.52,57.55 -3.8,57.55 -3.8,59.99
GND on Bottom Layer: -2.19,61.5 136.35,61.5 136.35,61.4 137.6,60.75 138.3,59.45 138.25,59.4 138.25,-2.43 136.78,-3.9 132.25,-3.9 132.25,54.76 131.3,56.28 130.33,57.05 129.33,57.45 -3.8,57.45 -3.8,59.89
GND on Bottom Layer: 4.25,3.18 4.25,54.57 5.25,55.57 5.25,55.57 68.63,55.57 70.15,54.05 70.15,42.75 72.85,40.05 72.85,7.25 70.25,4.65 70.25,3.06 69.48,2.29 4.94,2.29 4.25,2.98 4.25,3.23
(no net) on Top Layer: 86.85,54.35 88.05,55.55 103.43,55.57 104.95,54.05 104.95,3.65 103.55,2.25 88.35,2.25 86.85,3.75
(no net) on Top Layer: 106.95,3.65 106.95,54.05 107.54,54.98 108.47,55.57 128.43,55.57 129.61,54.98 130.15,53.85 130.15,3.65 128.75,2.25 108.35,2.25
(no net) on Bottom Layer: 103.53,55.57 104.75,54.35 104.75,3.55 103.45,2.25 88.45,2.25 86.95,3.75 86.95,54.36 88.18,55.57
(no net) on Bottom Layer: 128.5,55.57 129.57,54.94 130.15,53.92 130.15,3.65 128.75,2.25 108.25,2.25 106.85,3.65 106.85,54.11 107.53,54.94 108.32,55.57

## Text on the board
Ratline Layer: R5
